# EasyEDA Pro project PRO_project.eprj, board PCB1_1
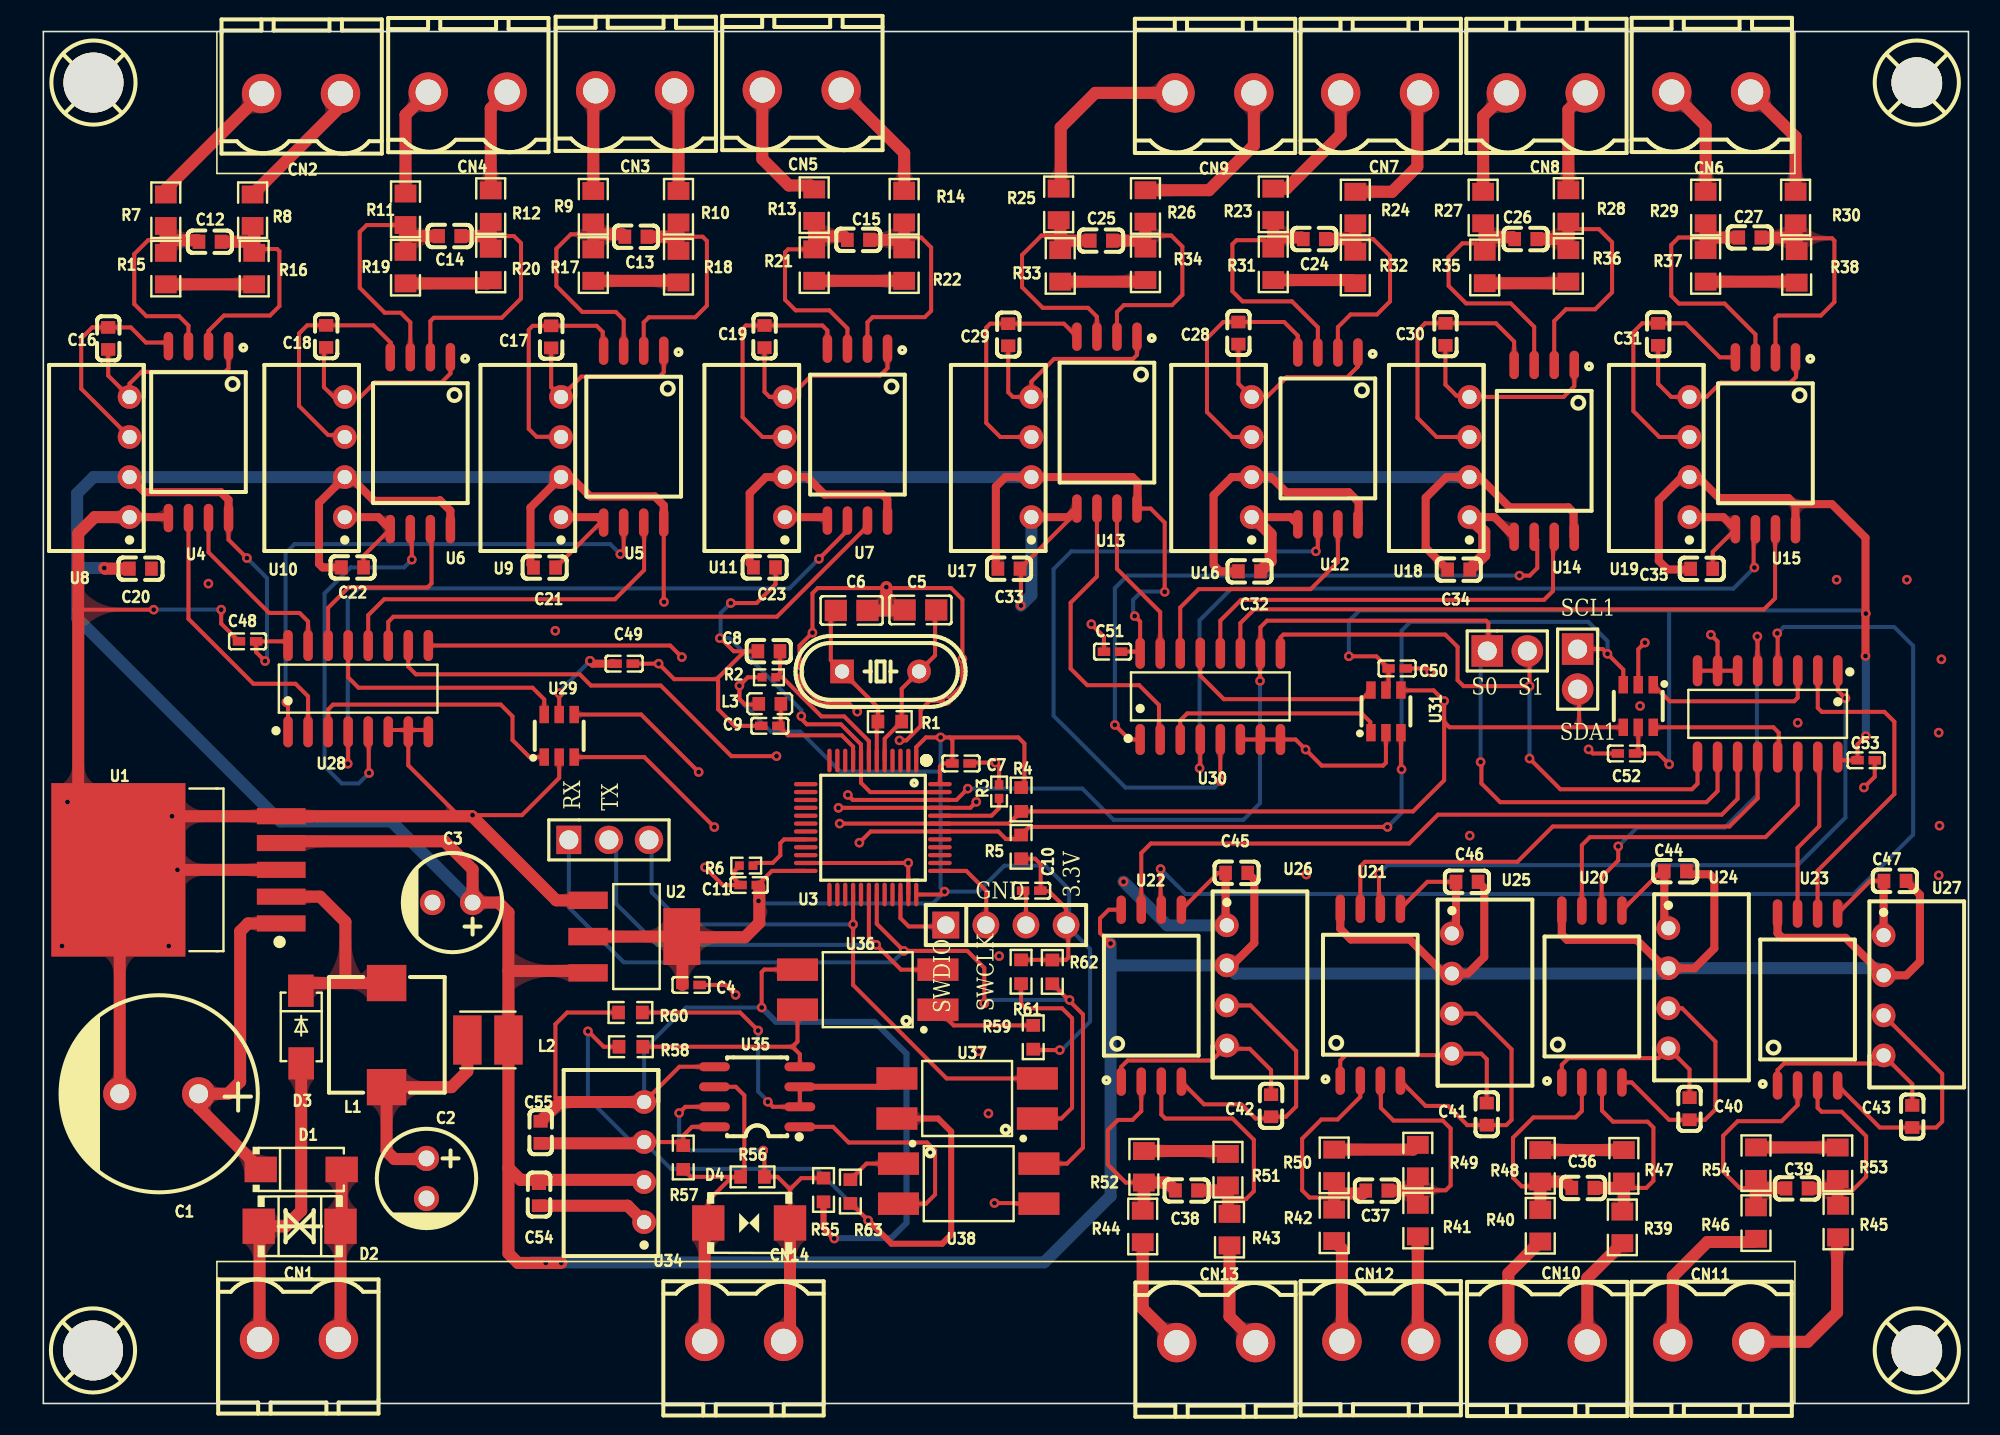
[diagram p17: board, top side]
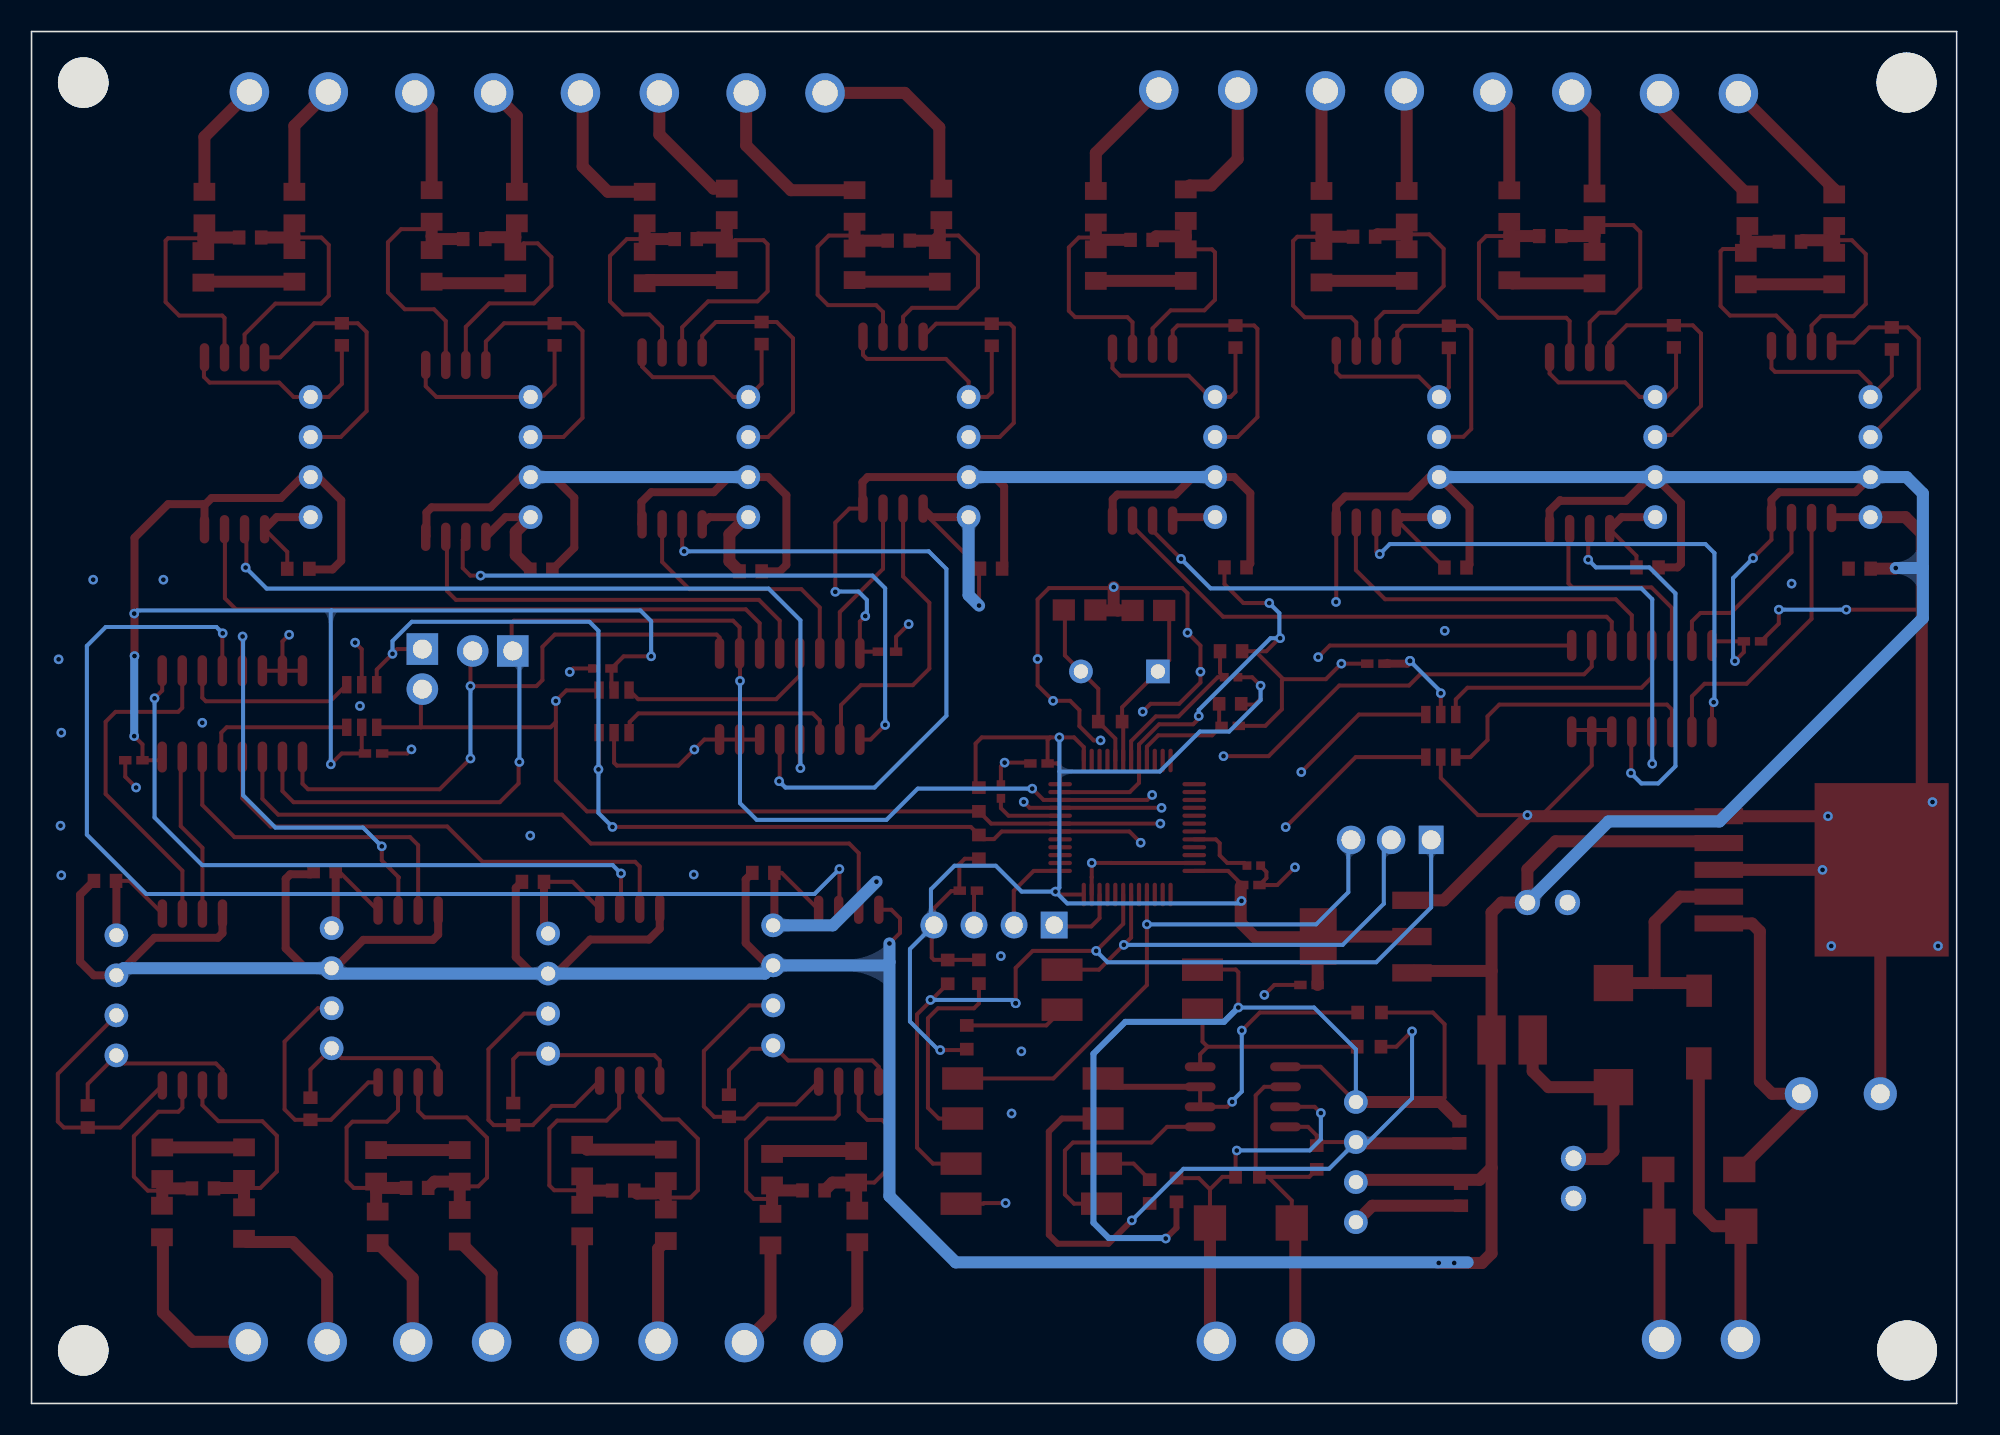
[diagram p18: board, bottom side, seen from below]

Outline 121.99 x 87 mm; copper layers: Top Layer, Inner1, Inner2, Bottom Layer. Coordinates in mm from the lower left corner of the outline.
Outline path: 0,87 121.99,87 121.99,0 0,0 0,87
Stack: Top Layer 0.035mm 外层铜厚1oz / Dielectric1 0.2104mm 7628 RC49% 8.6mil / Inner1 0.0152mm 内层铜厚 / Dielectric2 1.065mm 1.1mm H/HOZ 含铜 / Inner2 0.0152mm 内层铜厚 / Dielectric3 0.2104mm 7628 RC49% 8.6mil / Bottom Layer 0.035mm 外层铜厚1oz

## Design rules (mm)
template: 自定义配置
spacing copperThickness1oz (default): track to track 0.102, other pairs 0.152 to 0.3
spacing copperThickness2oz: track to track 0.203, other pairs 0.152 to 0.3
track width copperThickness1oz (default): min 0.127, default 0.254, max 2.54
track width copperThickness2oz: min 0.203, default 0.254, max 2.54
differential pair differentialPair (default): width min 0.127, default 0.254, max 2.54; gap min 0.152, default 0.152
via viaSize (default): diameter min 0.5, default 0.61, max 10; hole min 0.3, default 0.305, max 6.299

## Placement (name value [footprint] x y rotation side)
C1  680uF  [CAP-TH_BD12.5-P5.00-D0.6-FD]  7.34 19.64 180 top
C2  220uF  [CAP-TH_BD6.3-P2.50-D1.0-FD]  24.28 14.27 270 top
C3  220uF  [CAP-TH_BD6.3-P2.50-D1.0-FD]  25.93 31.77 180 top
C4  100nF  [C0402]  41.04 26.54 0 top
C5  22pF  [C0805]  55.58 50.32 180 top
C6  22pF  [C0805]  51.22 50.29 0 top
C7  100nF  [C0402]  58.15 40.59 180 top
C8  10uF  [C0603]  45.98 47.7 0 top
C9  100nF  [C0402]  46.04 42.97 180 top
C10  100nF  [C0402]  62.63 32.52 0 top
C11  100nF  [C0402]  44.73 32.88 0 top
C12  330pF  [C0603]  10.56 73.67 0 top
C13  330pF  [C0603]  37.55 73.99 180 top
C14  330pF  [C0603]  25.75 74.03 0 top
C15  330pF  [C0603]  51.65 73.79 0 top
C16  10uF  [C0603]  4.11 67.54 270 top
C17  10uF  [C0603]  32.18 67.64 270 top
C18  10uF  [C0603]  17.92 67.67 270 top
C19  10uF  [C0603]  45.7 67.66 270 top
C20  4.7uF  [C0603]  6.15 52.94 180 top
C21  4.7uF  [C0603]  31.76 53.01 180 top
C22  4.7uF  [C0603]  19.59 53.02 180 top
C23  4.7uF  [C0603]  45.7 53.02 180 top
C24  330pF  [C0603]  80.54 73.84 0 top
C25  330pF  [C0603]  67.04 73.74 0 top
C26  330pF  [C0603]  93.94 73.84 0 top
C27  330pF  [C0603]  108.14 73.94 0 top
C28  10uF  [C0603]  75.73 67.88 270 top
C29  10uF  [C0603]  61.15 67.77 270 top
C30  10uF  [C0603]  88.85 67.8 270 top
C31  10uF  [C0603]  102.33 67.8 270 top
C32  4.7uF  [C0603]  76.43 52.77 180 top
C33  4.7uF  [C0603]  61.19 52.94 180 top
C34  4.7uF  [C0603]  89.69 52.88 180 top
C35  4.7uF  [C0603]  105.09 52.93 180 top
C36  330pF  [C0603]  97.56 13.67 180 top
C37  330pF  [C0603]  84.5 13.5 180 top
C38  330pF  [C0603]  72.44 13.51 180 top
C39  330pF  [C0603]  111.13 13.64 180 top
C40  10uF  [C0603]  104.32 18.69 90 top
C41  10uF  [C0603]  91.47 18.35 90 top
C42  10uF  [C0603]  77.8 18.88 90 top
C43  10uF  [C0603]  118.44 18.2 90 top
C44  4.7uF  [C0603]  103.42 33.75 0 top
C45  4.7uF  [C0603]  75.62 33.65 0 top
C46  4.7uF  [C0603]  90.22 33.08 0 top
C47  4.7uF  [C0603]  117.34 33.14 0 top
C48  100nF  [C0402]  12.94 48.33 180 top
C49  100nF  [C0402]  36.81 46.91 0 top
C50  100nF  [C0402]  85.79 46.61 0 top
C51  100nF  [C0402]  67.76 47.67 180 top
C52  100nF  [C0402]  100.32 41.22 180 top
C53  100nF  [C0402]  115.51 40.79 0 top
C54  4.7uF  [C0603]  31.41 13.24 270 top
C55  10uF  [C0603]  31.51 17.2 270 top
CN1  WJ2EDGV-5.08-2P  [CONN-TH_WJ2EDGV-5.08-2P]  16.2 4.06 180 top
CN2  WJ2EDGV-5.08-2P  [CONN-TH_WJ2EDGV-5.08-2P]  16.33 83.07 0 top
CN3  WJ2EDGV-5.08-2P  [CONN-TH_WJ2EDGV-5.08-2P]  37.5 83.24 0 top
CN4  WJ2EDGV-5.08-2P  [CONN-TH_WJ2EDGV-5.08-2P]  26.89 83.16 0 top
CN5  WJ2EDGV-5.08-2P  [CONN-TH_WJ2EDGV-5.08-2P]  48.06 83.29 0 top
CN6  WJ2EDGV-5.08-2P  [CONN-TH_WJ2EDGV-5.08-2P]  105.69 83.17 0 top
CN7  WJ2EDGV-5.08-2P  [CONN-TH_WJ2EDGV-5.08-2P]  84.71 83.11 0 top
CN8  WJ2EDGV-5.08-2P  [CONN-TH_WJ2EDGV-5.08-2P]  95.21 83.11 0 top
CN9  WJ2EDGV-5.08-2P  [CONN-TH_WJ2EDGV-5.08-2P]  74.21 83.11 0 top
CN10  WJ2EDGV-5.08-2P  [CONN-TH_WJ2EDGV-5.08-2P]  95.34 3.9 180 top
CN11  WJ2EDGV-5.08-2P  [CONN-TH_WJ2EDGV-5.08-2P]  105.76 3.91 180 top
CN12  WJ2EDGV-5.08-2P  [CONN-TH_WJ2EDGV-5.08-2P]  84.79 3.95 180 top
CN13  WJ2EDGV-5.08-2P  [CONN-TH_WJ2EDGV-5.08-2P]  74.32 3.86 180 top
CN14  WJ2EDGV-5.08-2P  [CONN-TH_WJ2EDGV-5.08-2P]  44.41 3.94 180 top
D1  US1M  [SMA_L4.4-W2.8-LS5.4-RD]  16.34 14.84 0 top
D2  SMBJ26CA  [SMB_L4.4-W3.6-LS5.3-BI]  16.24 11.24 0 top
D3  SS54  [SMA_L4.3-W2.6-LS5.0-FD]  16.33 23.87 90 top
D4  P6SMB6.8CA/TR13  [SMB_L4.6-W3.6-LS5.3-BI]  44.73 11.45 0 top
H1  PZ254V-11-02P  [HDR-TH_2P-P2.54-V-M]  97.23 46.57 270 top
H2  PZ254V-11-04P  [HDR-TH_4P-P2.54-V-M]  61 30.34 0 top
H3  PZ254V-11-02P  [HDR-TH_2P-P2.54-V-M]  92.77 47.72 0 top
H4  2.54-1*3P针  [HDR-TH_3P-P2.54-V-M-1]  35.84 35.74 0 top
L1  100uH  [IND-SMD_L7.3-W7.3-1]  21.75 23.36 90 top
L2  33uH  [IND-SMD_L3.5-W3.0]  28.17 23.05 180 top
L3  GZ1608D601TF  [L0603]  46.04 44.37 0 top
R1  1MΩ  [R0603]  53.64 43.24 180 top
R2  10kΩ  [R0402]  45.98 46.05 180 top
R3  10kΩ  [R0402]  60.57 38.81 90 top
R4  10kΩ  [R0603]  61.96 38.3 270 top
R5  10kΩ  [R0603]  61.96 35.3 270 top
R6  10kΩ  [R0402]  44.54 34.11 0 top
R7  82kΩ  [R0805]  7.76 75.67 90 top
R8  82kΩ  [R0805]  13.26 75.67 90 top
R9  82kΩ  [R0805]  34.85 75.89 90 top
R10  82kΩ  [R0805]  40.25 75.89 90 top
R11  82kΩ  [R0805]  22.95 75.73 90 top
R12  82kΩ  [R0805]  28.35 75.93 90 top
R13  82kΩ  [R0805]  48.85 75.99 90 top
R14  82kΩ  [R0805]  54.55 75.89 90 top
R15  3.24kΩ  [R0805]  7.76 71.97 90 top
R16  3.24kΩ  [R0805]  13.36 71.97 90 top
R17  3.24kΩ  [R0805]  34.85 72.19 90 top
R18  3.24kΩ  [R0805]  40.25 72.09 90 top
R19  3.24kΩ  [R0805]  22.95 72.03 90 top
R20  3.24kΩ  [R0805]  28.35 72.23 90 top
R21  3.24kΩ  [R0805]  48.85 72.19 90 top
R22  3.24kΩ  [R0805]  54.55 72.19 90 top
R23  82kΩ  [R0805]  77.94 76.04 90 top
R24  82kΩ  [R0805]  83.14 75.84 90 top
R25  82kΩ  [R0805]  64.34 76.04 90 top
R26  82kΩ  [R0805]  69.84 75.94 90 top
R27  82kΩ  [R0805]  91.24 75.84 90 top
R28  82kΩ  [R0805]  96.64 75.94 90 top
R29  82kΩ  [R0805]  105.34 75.84 90 top
R30  82kΩ  [R0805]  111.04 75.84 90 top
R31  3.24kΩ  [R0805]  77.94 72.24 90 top
R32  3.24kΩ  [R0805]  83.14 72.04 90 top
R33  3.24kΩ  [R0805]  64.44 72.14 90 top
R34  3.24kΩ  [R0805]  69.84 72.24 90 top
R35  3.24kΩ  [R0805]  91.34 72.04 90 top
R36  3.24kΩ  [R0805]  96.64 72.14 90 top
R37  3.24kΩ  [R0805]  105.34 72.14 90 top
R38  3.24kΩ  [R0805]  111.11 72.08 90 top
R39  82kΩ  [R0805]  100.06 11.17 270 top
R40  82kΩ  [R0805]  94.86 11.27 270 top
R41  82kΩ  [R0805]  87.1 11.6 270 top
R42  82kΩ  [R0805]  81.8 11.3 270 top
R43  82kΩ  [R0805]  75.17 11.02 270 top
R44  82kΩ  [R0805]  69.67 11.22 270 top
R45  82kΩ  [R0805]  113.73 11.54 270 top
R46  82kΩ  [R0805]  108.53 11.44 270 top
R47  3.24kΩ  [R0805]  100.16 15.07 270 top
R48  3.24kΩ  [R0805]  94.86 15.07 270 top
R49  3.24kΩ  [R0805]  87.1 15.4 270 top
R50  3.24kΩ  [R0805]  81.8 15.1 270 top
R51  3.24kΩ  [R0805]  75.07 14.82 270 top
R52  3.24kΩ  [R0805]  69.74 15.01 270 top
R53  3.24kΩ  [R0805]  113.71 15.23 270 top
R54  3.24kΩ  [R0805]  108.53 15.24 270 top
R55  4.7kΩ  [R0603]  49.44 13.54 270 top
R56  120Ω  [R0603]  44.94 14.37 0 top
R57  4.7kΩ  [R0603]  40.55 15.6 270 top
R58  470Ω  [R0603]  37.23 22.62 180 top
R59  470Ω  [R0603]  62.73 23.22 90 top
R60  470Ω  [R0603]  37.2 24.79 0 top
R61  470Ω  [R0603]  61.96 27.38 270 top
R62  470Ω  [R0603]  63.94 27.37 270 top
R63  470Ω  [R0603]  51.14 13.44 270 top
SCREW1  -  [m3螺丝]  3.24 83.7 0 top
SCREW2  -  [M3螺丝]  118.79 83.7 0 top
SCREW3  -  [m3螺丝#2]  118.79 3.3 0 top
SCREW4  -  [m3螺丝]  3.21 3.3 0 top
U1  LM2596S-5.0  [TO-263-5_L10.2-W8.9-P1.70-BR]  9.91 33.84 0 top
U2  AMS1117-3.3  [SOT-223-3_L6.5-W3.4-P2.30-LS7.0-BR]  37.49 29.61 180 top
U3  STM32F103C8T6  [LQFP-48_L7.0-W7.0-P0.50-LS9.0-BL]  52.57 36.52 180 top
U4  AMC1200BDWVR  [SOIC-8_L5.9-W7.5-P1.27-LS11.5-BL]  9.83 61.6 180 top
U5  AMC1200BDWVR  [SOIC-8_L5.9-W7.5-P1.27-LS11.5-BL]  37.41 61.31 180 top
U6  AMC1200BDWVR  [SOIC-8_L5.9-W7.5-P1.27-LS11.5-BL]  23.89 60.9 180 top
U7  AMC1200BDWVR  [SOIC-8_L5.9-W7.5-P1.27-LS11.5-BL]  51.59 61.44 180 top
U8  -  [iCash-B0505-Right]  6.56 66.13 180 top
U9  -  [iCash-B0505-Right]  33.9 66.13 180 top
U10  -  [iCash-B0505-Right]  20.2 66.13 180 top
U11  -  [iCash-B0505-Right]  48.09 66.13 180 top
U12  AMC1200BDWVR  [SOIC-8_L5.9-W7.5-P1.27-LS11.5-BL]  81.4 61.2 180 top
U13  AMC1200BDWVR  [SOIC-8_L5.9-W7.5-P1.27-LS11.5-BL]  67.4 62.2 180 top
U14  AMC1200BDWVR  [SOIC-8_L5.9-W7.5-P1.27-LS11.5-BL]  95.11 60.41 180 top
U15  AMC1200BDWVR  [SOIC-8_L5.9-W7.5-P1.27-LS11.5-BL]  109.13 60.89 180 top
U16  -  [iCash-B0505-Right]  77.67 66.13 180 top
U17  -  [iCash-B0505-Right]  63.71 66.13 180 top
U18  -  [iCash-B0505-Right]  91.47 66.13 180 top
U19  -  [iCash-B0505-Right]  105.41 66.13 180 top
U20  AMC1200BDWVR  [SOIC-8_L5.9-W7.5-P1.27-LS11.5-BL]  98.13 25.81 0 top
U21  AMC1200BDWVR  [SOIC-8_L5.9-W7.5-P1.27-LS11.5-BL]  84.09 25.92 0 top
U22  AMC1200BDWVR  [SOIC-8_L5.9-W7.5-P1.27-LS11.5-BL]  70.21 25.86 0 top
U23  AMC1200BDWVR  [SOIC-8_L5.9-W7.5-P1.27-LS11.5-BL]  111.8 25.62 0 top
U24  -  [iCash-B0505-Right]  101.88 20.22 0 top
U25  -  [iCash-B0505-Right]  88.16 19.88 0 top
U26  -  [iCash-B0505-Right]  73.9 20.4 0 top
U27  -  [iCash-B0505-Right]  115.52 19.77 0 top
U28  74HC4052D,653  [SOIC-16_L9.9-W3.9-P1.27-LS6.0-BL]  19.95 45.33 0 top
U29  ADS1110A0IDBVR  [SOT-23-6_L2.9-W1.6-P0.95-LS2.8-BR]  32.69 42.34 270 top
U30  74HC4052D,653  [SOIC-16_L9.9-W3.9-P1.27-LS6.0-BL]  73.95 44.84 0 top
U31  ADS1110A0IDBVR  [SOT-23-6_L2.9-W1.6-P0.95-LS2.8-BR]  85.08 43.89 270 top
U32  74HC4052D,653  [SOIC-16_L9.9-W3.9-P1.27-LS6.0-BL]  109.27 43.73 180 top
U33  ADS1110A0IDBVR  [SOT-23-6_L2.9-W1.6-P0.95-LS2.8-BR]  101.07 44.23 90 top
U34  -  [iCash-B0505-Right]  39.17 21.42 180 top
U35  SP485EEN-L/TR  [SOIC-8_L5.0-W4.0-P1.27-LS6.0-BL]  45.23 19.45 90 top
U36  PC817C-S  [SOP-4_L6.5-W4.6-P2.54-LS10.3-TL]  52.24 26.24 180 top
U37  PC817C-S  [SOP-4_L6.5-W4.6-P2.54-LS10.3-TL]  58.54 19.34 180 top
U38  PC817C-S  [SOP-4_L6.5-W4.6-P2.54-LS10.3-TL]  58.64 13.94 0 top
X1  8MHz  [HC-49US_L11.5-W4.5-P4.88]  53.05 46.42 0 top

## Footprints (pads in the part's own frame, mm; a bottom-side part is the same pattern mirrored in y, then rotated)
C0402
  rect 0.79x0.54 smd: 1(-0.545,0) 2(0.545,0)
C0603
  rect 0.8x0.9 smd: 1(-0.7,0) 2(0.7,0)
C0805
  rect 1.41x1.35 smd: 1(-1,0) 2(1,0)
CAP-TH_BD6.3-P2.50-D1.0-FD
  round 1.6 hole 1: 1(-1.27,0) 2(1.27,0)
CAP-TH_BD12.5-P5.00-D0.6-FD
  round 2.1 hole 1.2: 1(-2.5,0) 2(2.5,0)
CONN-TH_WJ2EDGV-5.08-2P
  round 2.5 hole 1.6: 1(-2.499,0) 2(2.499,0)
HC-49US_L11.5-W4.5-P4.88
  rect 1.5x1.5 hole 0.9: 1(-2.44,0)
  round 1.5 hole 0.9: 2(2.44,0)
HDR-TH_2P-P2.54-V-M
  rect 2x2 hole 1.2: 1(-1.27,0)
  round 2 hole 1.2: 2(1.27,0)
HDR-TH_3P-P2.54-V-M-1
  rect 1.575x1.8 hole 1.2: 1(-2.54,0)
  round 1.8 hole 1.2: 2(0,0) 3(2.54,0)
HDR-TH_4P-P2.54-V-M
  rect 1.7x1.7 hole 1.1: 1(-3.81,0)
  round 1.7 hole 1.1: 2(-1.27,0) 3(1.27,0) 4(3.81,0)
iCash-B0505-Right
  round 1.5 hole 0.9: 1(1.099,9.922) 2(1.099,7.382) 3(1.099,4.842) 4(1.099,2.302)
IND-SMD_L3.5-W3.0
  rect 1.8x3.12 smd: 1(1.303,0) 2(-1.303,0)
IND-SMD_L7.3-W7.3-1
  rect 2.3x2.5 smd: 1(-3.3,0) 2(3.3,0)
L0603
  rect 0.8x0.864 smd: 1(-0.7,0) 2(0.7,0)
LQFP-48_L7.0-W7.0-P0.50-LS9.0-BL
  oval 0.27x1.5 smd: 1(-2.75,-4.25) 2(-2.25,-4.25) 3(-1.75,-4.25) 4(-1.25,-4.25) 5(-0.75,-4.25) 6(-0.25,-4.25) 7(0.25,-4.25) 8(0.75,-4.25) 9(1.25,-4.25) 10(1.75,-4.25) 11(2.25,-4.25) 12(2.75,-4.25) 25(2.75,4.25) 26(2.25,4.25) 27(1.75,4.25) 28(1.25,4.25) 29(0.75,4.25) 30(0.25,4.25) 31(-0.25,4.25) 32(-0.75,4.25) 33(-1.25,4.25) 34(-1.75,4.25) 35(-2.25,4.25) 36(-2.75,4.25)
  oval 1.5x0.27 smd: 13(4.25,-2.75) 14(4.25,-2.25) 15(4.25,-1.75) 16(4.25,-1.25) 17(4.25,-0.75) 18(4.25,-0.25) 19(4.25,0.25) 20(4.25,0.75) 21(4.25,1.25) 22(4.25,1.75) 23(4.25,2.25) 24(4.25,2.75) 37(-4.25,2.75) 38(-4.25,2.25) 39(-4.25,1.75) 40(-4.25,1.25) 41(-4.25,0.75) 42(-4.25,0.25) 43(-4.25,-0.25) 44(-4.25,-0.75) 45(-4.25,-1.25) 46(-4.25,-1.75) 47(-4.25,-2.25) 48(-4.25,-2.75)
m3螺丝
  round 3.8 hole 3.8: 1(-0.064,0.064)
m3螺丝#2
  round 3.2 hole 3.8x3.2: 1(-0.064,0.064)
M3螺丝
  round 3.2 hole 3.2: 1(-0.064,0.064)
R0402
  rect 0.566x0.54 smd: 1(-0.433,0) 2(0.433,0)
R0603
  rect 0.806x0.864 smd: 1(-0.753,0) 2(0.753,0)
R0805
  rect 1.133x1.377 smd: 1(-1,0) 2(1,0)
SMA_L4.3-W2.6-LS5.0-FD
  rect 2.046x1.62 smd: 1(-2.304,-0.009) 2(2.304,0.009)
SMA_L4.4-W2.8-LS5.4-RD
  rect 2.046x1.62 smd: 1(-2.566,0) 2(2.566,0)
SMB_L4.4-W3.6-LS5.3-BI
  rect 2.047x2.241 smd: 1(-2.591,0) 2(2.591,0)
SMB_L4.6-W3.6-LS5.3-BI
  rect 2.047x2.241 smd: 1(-2.591,0) 2(2.591,0)
SOIC-8_L5.0-W4.0-P1.27-LS6.0-BL
  oval 0.569x1.95 smd: 1(-1.905,-2.705) 2(-0.635,-2.705) 3(0.635,-2.705) 4(1.905,-2.705) 5(1.905,2.705) 6(0.635,2.705) 7(-0.635,2.705) 8(-1.905,2.705)
SOIC-8_L5.9-W7.5-P1.27-LS11.5-BL
  oval 0.6x1.8 smd: 1(-1.905,-5.45) 2(-0.635,-5.45) 3(0.635,-5.45) 4(1.905,-5.45) 5(1.905,5.45) 6(0.635,5.45) 7(-0.635,5.45) 8(-1.905,5.45)
SOIC-16_L9.9-W3.9-P1.27-LS6.0-BL
  oval 0.602x1.971 smd: 1(-4.445,-2.736) 2(-3.175,-2.736) 3(-1.905,-2.736) 4(-0.635,-2.736) 5(0.635,-2.736) 6(1.905,-2.736) 7(3.175,-2.736) 8(4.445,-2.736) 9(4.445,2.736) 10(3.175,2.736) 11(1.905,2.736) 12(0.635,2.736) 13(-0.635,2.736) 14(-1.905,2.736) 15(-3.175,2.736) 16(-4.445,2.736)
SOP-4_L6.5-W4.6-P2.54-LS10.3-TL
  rect 2.6x1.423 smd: 1(-4.45,1.27) 2(-4.45,-1.27) 3(4.45,-1.27) 4(4.45,1.27)
SOT-23-6_L2.9-W1.6-P0.95-LS2.8-BR
  rect 1.1x0.6 smd: 1(1.35,-0.95) 2(1.35,0) 3(1.35,0.95) 4(-1.35,0.95) 5(-1.35,0) 6(-1.35,-0.95)
SOT-223-3_L6.5-W3.4-P2.30-LS7.0-BR
  rect 2.5x1.1 smd: 1(2.97,-2.3) 2(2.97,0) 3(2.97,2.3)
  rect 2.34x3.6 smd: 4(-2.97,0)
TO-263-5_L10.2-W8.9-P1.70-BR
  rect 3.083x1.02 smd: 1(5.16,-3.4) 2(5.16,-1.7) 3(5.16,0) 4(5.16,1.7) 5(5.16,3.4)
  rect 8.5x11 smd: 6(-5.16,0)

## Nets
As in the schematic, except:
SS485: H4.3 U3.28 U37.2
X1_1: C5.1 R1.1 U3.5 X1.2
X1_2: C6.1 R1.2 U3.6 X1.1

Pads without a net: SCREW1 1; SCREW2 1; SCREW3 1; SCREW4 1; U3 2 3 4 10 11 12 13 14 15 16 17 18 19 21 22 25 26 27 29 32 33 38 39 40 41

## Via types
v1: diameter 0.61, hole 0.305, Top Layer to Bottom Layer, 121 vias

## Routing (per net, layer and track width the routed paths; a pad name or vN(x,y) marks a point on that pad's centre or on a via; arc(x,y) is an arc through that point)
3.3V: length 112.4
  Top Layer w0.254: U3.1 55.32,41.62 55.93,42.24 v1(56.86,42.24) 57.44,42.24 ; R61.1 63.93,28.13 ; 63.93,28.13 64.81,28.13 64.95,28.27 64.95,30.2 H2.4 64.81,31.4 63.72,32.49 63.11,32.49 63.2,32.58 63.2,34.2 62.86,34.54 R5.2 ; 63.93,28.13 R62.1 ; v1(57.11,32.46) 56.92,32.27 U3.36 ; 57.44,42.24 57.61,42.07 C7.2 57.61,40.59 57,40.59 56.82,40.4 U3.48 ; 57.44,42.24 61.78,42.24 62.17,41.85 62.17,39.26 R4.1 ; v1(64.41,22.41) 62.79,22.41 R59.1 ; L3.1 45.29,44.32 44.47,44.32 44.11,44.68 v1(44.11,45.52) 44.64,46.05 R2.2 ; v1(45.32,31.87) 45.37,31.87 ; U3.24 46.17,33.77 C11.2
  Top Layer w0.762: 40.5,29.57 U2.4 U2.2 ; 40.5,29.57 40.5,26.54 ; 40.5,29.57 44.46,29.57 45.37,30.48 45.37,32.78
  Bottom Layer w0.254: v1(57.11,32.46) 56.86,32.71 56.86,40.07 ; v1(57.11,32.46) 59.25,32.46 60.89,34.1 63.51,34.1 65,32.61 65,30.53 H2.4 66.33,28.82 66.33,24.22 64.52,22.41 v1(64.41,22.41) ; v1(57.11,32.46) 56.36,31.71 45.41,31.71 45.32,31.8 v1(45.32,31.87) ; 56.86,40.07 v1(56.86,42.24) ; 56.86,40.07 50.5,40.07 47.96,42.61 46.1,42.61 44.11,44.6 v1(44.11,45.52)
3.3VA: length 7.6
  Top Layer w0.254: U3.9 51.32,41.65 50.6,42.37 47.18,42.37 C9.1 46.74,43.12 L3.2
+5V: length 619.9
  Top Layer w0.254: v1(115.49,50.09) 115.47,50.07 ; U29.5 v1(32.69,45.04) 32.67,45.06 ; v1(67.63,29.17) 66.96,29.84 66.96,30.76 67.51,31.31 U22.8 ; U33.5 101.07,41.42 C52.1 102.34,41.22 v1(103.03,40.53) ; U32.16 113.92,40.79 114.97,40.79 114.97,41.79 v1(115.49,42.32) ; U31.5 85.25,45.4 85.25,46.61 84.48,47.38 v1(82.73,47.38) ; U5.8 39.32,50.84 v1(39.33,50.83) ; v1(14.05,47.08) 13.49,47.64 C48.1 15.24,48.33 15.51,48.06 ; U13.8 70.17,56.75 71.06,55.86 v1(71.06,51.47) ; U4.8 11.74,54.77 v1(12.9,53.61) ; 36.08,47.09 C49.1 ; C51.1 69.41,47.67 U30.16 69.51,49.58 v1(69.16,49.93)
  Top Layer w0.508: C49.1 34.82,46.91 v1(34.64,47.09) ; C21.2 30.87,53.2 30.87,56.82 U9.2 33.42,58.75 34.65,57.52 38.75,57.52 39.32,56.95 39.32,55.86 U5.8 ; U4.8 11.74,57.3 11.25,57.79 6.42,57.79 U8.2 ; C23.2 44.76,53.26 44.76,57.72 45.79,58.75 U11.2 48.39,58.75 49.5,57.64 53.18,57.64 53.48,57.34 53.48,56 U7.8 ; U26.2 75.32,27.78 76.74,29.2 76.74,33.23 C45.2 ; C33.2 60.36,53.07 60.36,58.14 60.97,58.75 U17.2 69.01,58.75 69.34,58.42 69.34,56.78 U13.8 ; 111.04,56.96 110.58,57.42 106.19,57.42 104.86,58.75 U19.2 103.84,58.75 102.37,57.28 102.37,53.44 102.92,52.89 104.35,52.89 C35.2 ; 111.04,56.96 U15.8 ; 111.04,56.96 111.1,57.03 113.34,57.03 115.47,54.9 v1(115.47,47.4) ; U20.8 96.23,29.73 96.56,29.4 100.97,29.4 102.77,27.6 U24.2 104.63,27.6 105.89,28.86 105.89,33.27 105.6,33.56 104.31,33.56 C44.2 ; U14.8 96.97,55 96.97,56.5 96.64,56.83 92.91,56.83 90.99,58.75 U18.2 88.91,58.75 87.6,57.44 87.6,54.27 C34.2 ; C32.2 74.57,52.77 74.16,53.18 74.16,57.6 75.31,58.75 U16.2 77.8,58.75 78.76,57.79 82.72,57.79 83.35,57.16 83.35,55.79 U12.8 ; C22.2 17.69,53.02 17.47,53.24 17.47,57.12 U10.2 19.45,58.75 20.96,57.24 25.09,57.24 25.13,57.28 25.8,56.61 U6.8 ; U23.8 109.9,29.82 110.19,29.53 114.21,29.53 116.59,27.15 U27.2 118.05,27.15 118.92,28.02 118.92,32.26 C47.2 ; U21.8 82.19,30.1 82.87,29.42 86.59,29.42 88.75,27.26 U25.2 90.26,27.26 91.31,28.31 91.31,32.69 C46.2